# EasyEDA Pro project ProProject_Avaota Pi A_2024-03-25.epro, board PCB2 (continued)
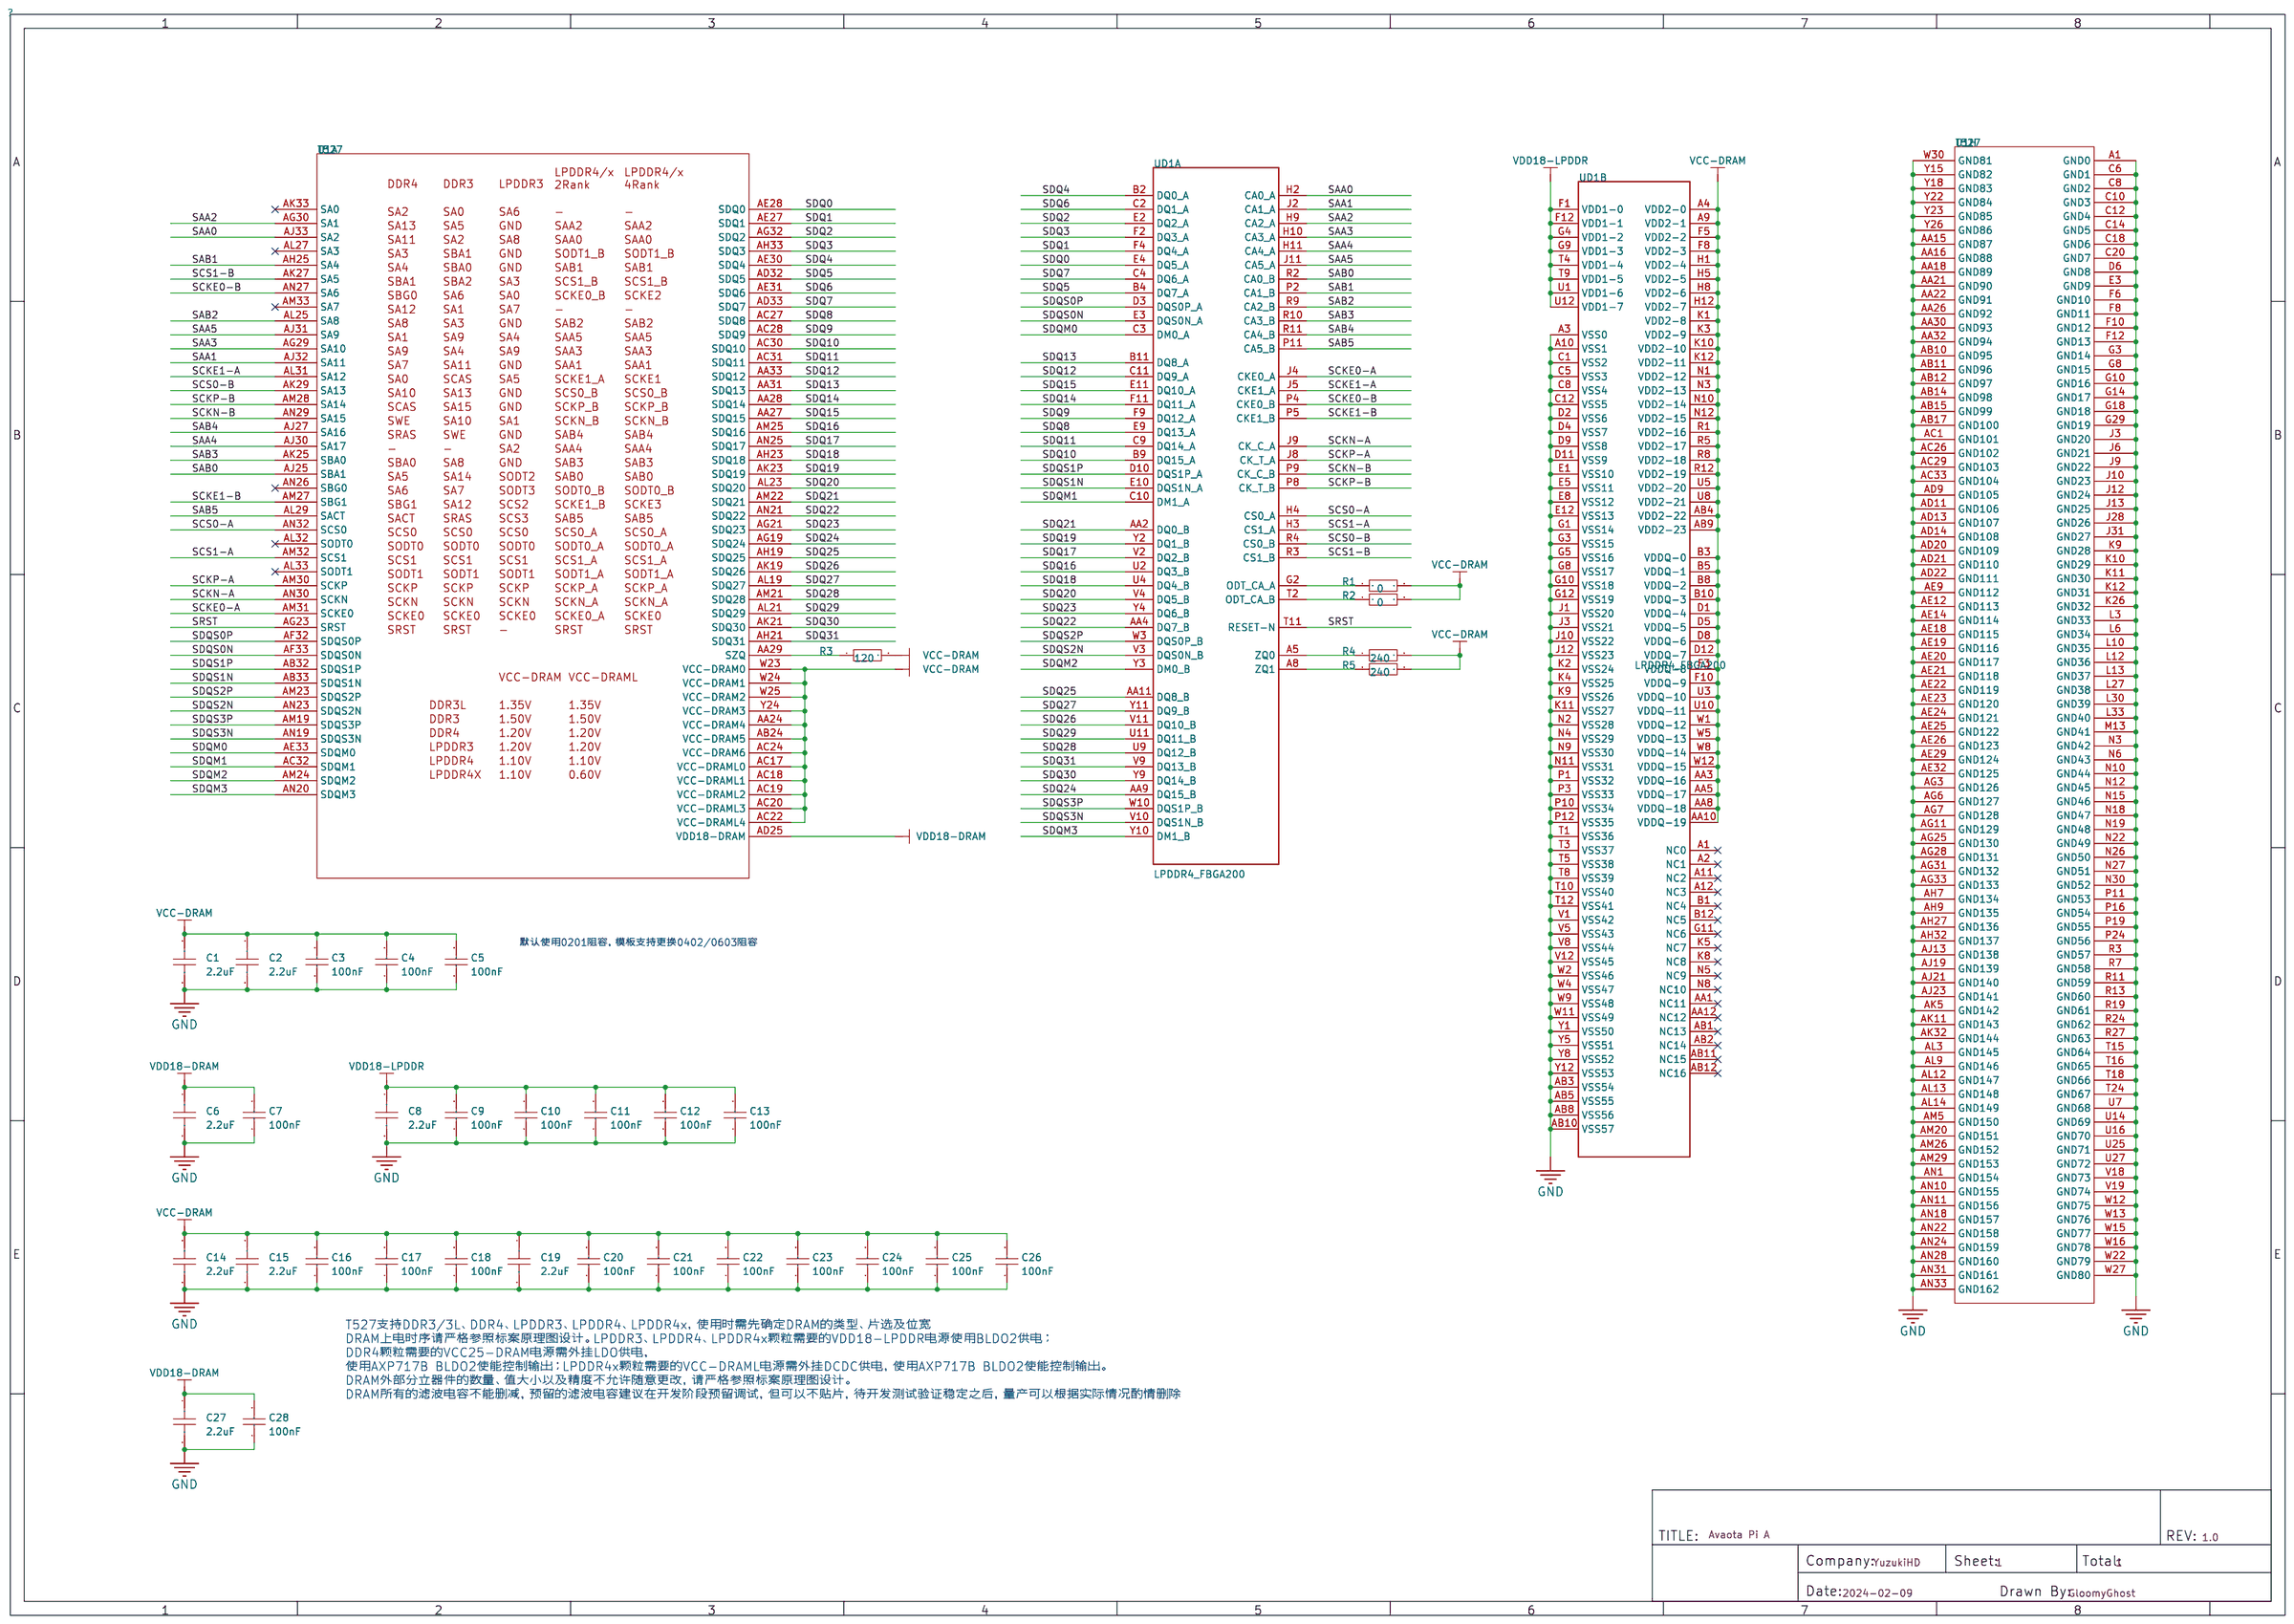
[diagram p0: schematic sheet]
## Routing (per net, layer and track width the routed paths; a pad name or vN(x,y) marks a point on that pad's centre or on a via; arc(x,y) is an arc through that point) (continued)
SDQM3: length 22.9
  Top Layer w0.076: 21.41,9.2 21.64,8.97 21.78,8.97 21.81,8.94 22.08,8.94 22.44,8.58 22.44,8.58 22.63,8.4 22.63,8.39 22.77,8.25 22.77,7.87
  Top Layer w0.115: 39.54,7.02 39.17,6.64 39.17,5.05 38.94,4.83 37.85,4.83 36.79,3.77 28.56,3.77 27.91,4.41 26.95,4.41 26.88,4.34 26.3,4.34 22.77,7.87
SDQS0N: length 14.4
  Top Layer w0.076: 24.92,17.32 24.91,17.32 24.88,17.3 24.82,17.3 24.8,17.27 24.58,17.27 23.58,16.27 23.53,16.27
  Top Layer w0.097: v1(33.62,17.09) 33.94,16.77
  Top Layer w0.127: 29.58,19.08 29.62,19.05 29.62,19.04 v1(29.7,19.04) ; 24.92,17.32 25.21,17.32 27.55,19.66 29.09,19.66 29.37,19.39 29.37,19.29 29.57,19.08 29.58,19.08
  Inner2 w0.127: v1(29.7,19.04) 29.61,19.04 29.42,19.24 29.42,19.34 29.55,19.47 30.97,19.47 32.25,18.19 32.8,18.19 33.02,17.96 33.02,17.61 33.26,17.37 33.51,17.37 33.62,17.26 v1(33.62,17.09)
SDQS0P: length 14.6
  Top Layer w0.076: 23.17,15.91 23.11,15.98 23.11,16.08 23.18,16.14 23.29,16.14 23.42,16.02 23.63,16.02 23.78,16.16 23.78,16.18 24.67,17.07 24.92,17.07
  Top Layer w0.097: v1(33.62,17.74) 33.94,17.42
  Top Layer w0.127: 24.92,17.07 25.31,17.07 27.65,19.41 28.99,19.41 29.11,19.29 v1(29.11,19.02)
  Inner2 w0.127: v1(33.62,17.74) 33.62,17.71 33.57,17.66 33.38,17.66 33.31,17.73 33.31,18.08 32.92,18.48 32.38,18.48 31.09,19.76 29.43,19.76 29.13,19.46 29.13,19.03 v1(29.11,19.02)
SDQS1N: length 26.2
  Top Layer w0.076: 22.11,17.68 22.23,17.68 22.78,18.24 22.84,18.24 23.03,18.43 23.03,18.54
  Top Layer w0.097: 39.54,16.77 39.5,16.77 v1(39.17,17.09)
  Top Layer w0.127: 23.03,18.54 23.03,18.76 26.75,22.48 28.57,22.48 28.77,22.29 38.35,22.29 39.28,21.36 39.28,20.97 39.78,20.47 v1(40.06,20.47)
  Inner2 w0.127: v1(39.17,17.09) 39.29,17.22 39.64,17.22 40.64,18.22 40.64,19.97 40.34,20.27 40.26,20.27 v1(40.06,20.47)
SDQS1P: length 26.3
  Top Layer w0.076: 21.76,17.33 21.76,17.3 21.86,17.19 21.94,17.19 21.99,17.25 21.99,17.36 22.06,17.43 22.21,17.43 22.87,18.08 22.91,18.08 23.29,18.47 23.29,18.54
  Top Layer w0.097: 39.54,17.42 39.5,17.42 v1(39.17,17.74)
  Top Layer w0.127: v1(39.9,19.81) 39.67,20.04 39.67,20.23 39.02,20.88 39.02,21.26 38.25,22.03 28.66,22.03 28.47,22.23 26.86,22.23 23.29,18.65 23.29,18.54
  Inner2 w0.104: 39.17,17.58 v1(39.17,17.74)
  Inner2 w0.127: v1(39.9,19.81) 40.07,19.98 40.22,19.98 40.35,19.85 40.35,18.34 39.52,17.51 39.25,17.51 39.17,17.58 v1(39.17,17.74)
SDQS2N: length 15.1
  Top Layer w0.076: 24.7,8.88 24.7,8.89 24.66,8.89 23.9,9.64 23.02,9.64 22.68,9.99 22.68,10.1 22.73,10.15 22.73,10.26 22.66,10.34 22.55,10.34 22.47,10.26
  Top Layer w0.127: 24.7,8.88 26.7,6.88 28.77,6.88 29.06,7.18 v1(29.06,7.29) ; 33.94,8.32 33.94,8.16 33.48,7.7 33.48,7.34 v1(33.53,7.29)
  Inner2 w0.127: v1(33.53,7.29) 33.63,7.29 33.75,7.16 33.75,7.08 33.5,6.83 30.49,6.83 30.18,7.14 29.21,7.14 v1(29.06,7.29)
SDQS2P: length 15.1
  Top Layer w0.076: 24.52,8.7 24.52,8.73 23.82,9.44 22.93,9.44 22.21,10.16 22.11,10.61
  Top Layer w0.127: v1(29.06,6.65) 29.03,6.63 26.59,6.63 24.52,8.7 ; 33.94,7.67 v1(34.29,7.32)
  Inner2 w0.127: v1(29.06,6.65) 29.25,6.84 30.05,6.84 30.37,6.53 33.62,6.53 34.05,6.96 34.05,7.08 v1(34.29,7.32)
SDQS3N: length 26.3
  Top Layer w0.076: 22.32,7.61 22.28,7.61 21.05,8.84
  Top Layer w0.127: 22.32,7.61 27.11,2.82 37.98,2.82 38.71,3.56 38.71,3.81 38.58,3.94 v1(38.53,3.94) ; 39.54,8.32 39.54,8.31 39.54,8.11 39.75,7.9 v1(39.96,7.9)
  Inner2 w0.127: v1(39.96,7.9) 39.78,7.9 39.56,7.67 39.56,7.03 39.3,6.77 39.3,5.24 38.72,4.67 38.72,4.13 v1(38.53,3.94)
SDQS3P: length 26.4
  Top Layer w0.076: 22.17,7.4 22.17,7.44 21.09,8.52 21.03,8.52 20.79,8.75 20.7,9.2
  Top Layer w0.127: v1(39.09,3.91) 39.01,3.83 39.01,3.5 38.08,2.57 27,2.57 22.17,7.4 ; 39.54,7.67 v1(39.96,7.25)
  Inner2 w0.127: v1(39.09,3.91) 39.02,3.99 39.02,4.55 39.59,5.12 39.59,6.64 39.85,6.91 39.85,7.14 v1(39.96,7.25)
SRST: length 23.1
  Top Layer w0.102: v1(39.95,9.38) 40,9.42 40.15,9.42 40.34,9.62
  Top Layer w0.115: v1(20.7,12.71) 20.7,12.69 20.39,12.38 20.35,12.38
  Inner2 w0.076: 24.7,10.35 23.82,11.23 23.1,11.23 21.63,12.7 20.74,12.7 20.73,12.7 20.72,12.7 v1(20.7,12.71)
  Inner2 w0.115: v1(39.95,9.38) 39.9,9.38 39.33,8.81 38.65,8.81 37.86,8.03 37.86,8 37.64,7.78 32.77,7.78 32.56,7.57 31.38,7.57 31.09,7.86 28.25,7.86 25.76,10.35 24.7,10.35
$2N2017: length 1.2
  Top Layer w0.115: v1(20.01,16.99) 20.01,16.94 U1.AA29
  Bottom Layer w0.115: v1(20.01,16.99) 20.19,16.82 R3.1
$2N2070: length 1.6
  Top Layer w0.115: v1(35.51,19.87) 35.54,19.84 35.54,19.37
  Bottom Layer w0.115: R4.1 36.04,20.08 35.72,20.08 v1(35.51,19.87)
$2N2072: length 1.1
  Top Layer w0.115: 37.94,19.37 37.94,19.8 v1(38.03,19.89)
  Bottom Layer w0.115: 38.12,19.39 38.12,19.8 v1(38.03,19.89)
$2N2081: length 3.7
  Top Layer w0.115: R1.1 31.2,16.08 31.39,15.88 31.39,15.49 31.69,15.2 32.87,15.2 33.14,15.47
$2N2083: length 3.5
  Top Layer w0.115: 33.11,9.62 32.79,9.93 31.93,9.93 31.3,9.3 30.53,9.3 30.28,9.55 30.28,9.71 30.29,9.7

## Copper pours and planes (outline as drawn; the poured copper is in the pictures)
GND on Top Layer: 0,26.8 45.69,26.8 45.69,0 0,0
GND on Bottom Layer: 0,26.9 45.69,26.9 45.69,0 0,0
GND on Inner1: 0,26.77 45.69,26.77 45.69,0 0,0
GND on Inner1: 17.27,16.18 25.35,24.26 39.55,24.26 43.51,20.29 43.51,4.65 40.74,1.88 25.25,1.88 17.27,9.86
GND on Inner2: 0,26.8 45.69,26.8 45.69,0 0,0
VCC-DRAM on Bottom Layer: 17.35,9.75 17.35,16.26 25.43,24.33 39.57,24.33 43.56,20.34 43.56,5 40.39,1.83 25.45,1.83 17.53,9.75
